# EasyEDA Pro project PRO_project.eprj, schematic Schematic1 (continued)
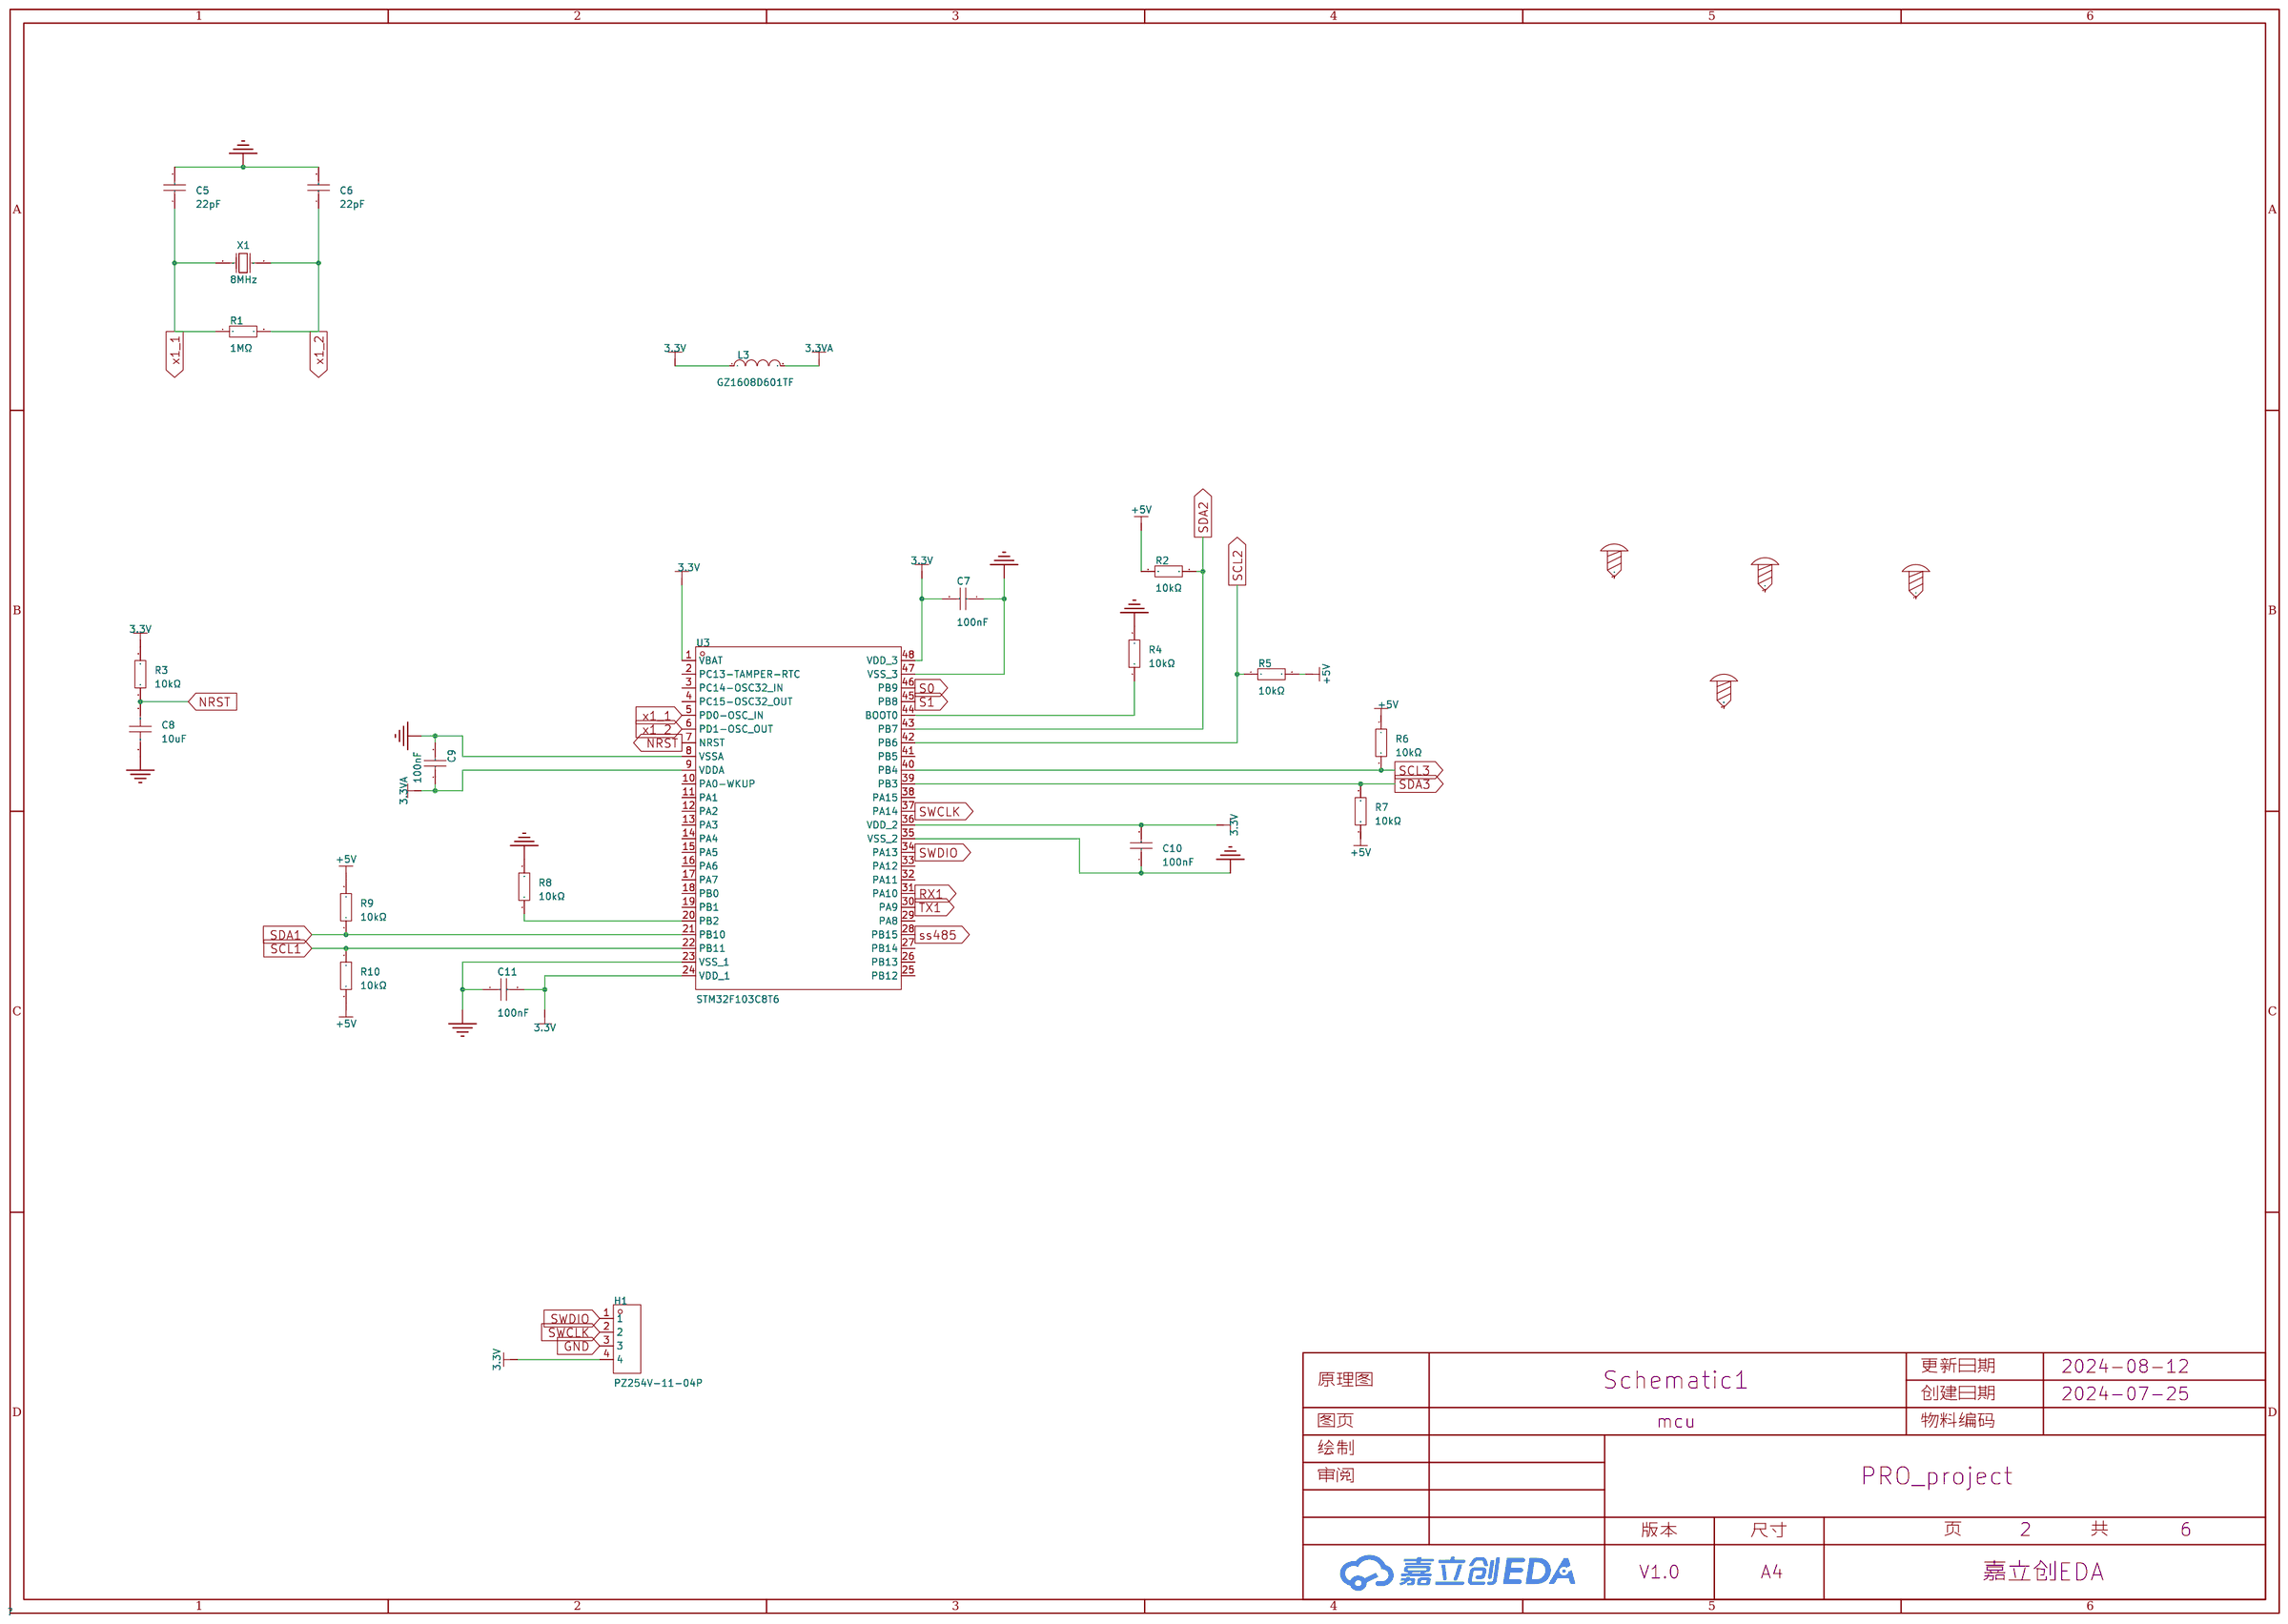
[diagram p0: mcu]
## Parts (continued)
L3  GZ1608D601TF  [L0603]
R1  1MΩ  [R0603]
R2  10kΩ  [R0603]
R3  10kΩ  [R0402]
R4  10kΩ  [R0402]
R5  10kΩ  [R0603]
R6  10kΩ  [R0603]
R7  10kΩ  [R0603]
R8  10kΩ  [R0402]
R9  10kΩ  [R0603]
R10  10kΩ  [R0603]
SCREW1  -  [M3螺丝]
SCREW2  -  [M3螺丝]
SCREW3  -  [M3螺丝]
SCREW4  -  [M3螺丝]
U3  STM32F103C8T6  [LQFP-48_L7.0-W7.0-P0.50-LS9.0-BL]
X1  8MHz  [HC-49US_L11.5-W4.5-P4.88]
sheet power
C1  680uF  [CAP-TH_BD12.5-P5.00-D0.6-FD]
C2  220uF  [CAP-TH_BD6.3-P2.50-D1.0-FD]
C3  220uF  [CAP-TH_BD6.3-P2.50-D1.0-FD]
C4  100nF  [C0402]
CN1  WJ2EDGV-5.08-2P  [CONN-TH_WJ2EDGV-5.08-2P]
D1  US1M  [SMA_L4.4-W2.8-LS5.4-RD]
D2  SMBJ26CA  [SMB_L4.4-W3.6-LS5.3-BI]
D3  SS54  [SMA_L4.3-W2.6-LS5.0-FD]
L1  100uH  [IND-SMD_L7.3-W7.3-1]
L2  33uH  [IND-SMD_L3.5-W3.0]
U1  LM2596S-5.0  [TO-263-5_L10.2-W8.9-P1.70-BR]
U2  AMS1117-3.3  [SOT-223-3_L6.5-W3.4-P2.30-LS7.0-BR]
sheet rs485
C54  4.7uF  [C0603]
C55  10uF  [C0603]
CN14  WJ2EDGV-5.08-2P  [CONN-TH_WJ2EDGV-5.08-2P]
D4  P6SMB6.8CA/TR13  [SMB_L4.6-W3.6-LS5.3-BI]
R59  4.7kΩ  [R0603]
R60  120Ω  [R0603]
R61  4.7kΩ  [R0603]
R62  470Ω  [R0603]
R63  470Ω  [R0603]
R64  470Ω  [R0603]
R65  470Ω  [R0603]
R66  470Ω  [R0603]
R67  470Ω  [R0603]
U34  SP485EEN-L/TR  [SOIC-8_L5.0-W4.0-P1.27-LS6.0-BL]
U35  PC817C-S  [SOP-4_L6.5-W4.6-P2.54-LS10.3-TL]
U36  -  [iCash-B0505-Right]
U37  PC817C-S  [SOP-4_L6.5-W4.6-P2.54-LS10.3-TL]
U38  PC817C-S  [SOP-4_L6.5-W4.6-P2.54-LS10.3-TL]

## Library data of the parts
C12-C15 C24-C27 C36-C39 = 0603B331K500NT: 容值:330pF;精度:±10%;额定电压:50V;材质(温度系数):X7R;; LCSC Part Name: 330pF ±10% 50V; Supplier Part: C1612; Manufacturer: FH(风华); Supplier Footprint: 0603; JLCPCB Part Class: Extended Part; Datasheet: https://atta.szlcsc.com/upload/public/pdf/source/20200305/C486355_26A10D38EF8C2A5C37091D0039909270.pdf; Supplier: LCSC; Tolerance: ±10%; Voltage Rated: 50V; Temperature Coefficient: X7R
C8 C16-C19 C28-C31 C40-C43 C55 = CL10A106KP8NNNC: 容值:10uF;精度:±10%;额定电压:10V;材质(温度系数):X5R;; LCSC Part Name: 10uF ±10% 10V; Supplier Part: C19702; Manufacturer: SAMSUNG(三星); Supplier Footprint: 0603; JLCPCB Part Class: Basic Part; Datasheet: https://atta.szlcsc.com/upload/public/pdf/source/20160218/1457707763339.pdf; Supplier: LCSC; Tolerance: ±10%; Voltage Rated: 10V; Temperature Coefficient: X5R
C20-C23 C32-C35 C44-C47 C54 = CL10A475KO8NNNC: 容值:4.7uF;精度:±10%;额定电压:16V;材质(温度系数):X5R;; LCSC Part Name: 4.7uF ±10% 16V; Supplier Part: C19666; Manufacturer: SAMSUNG(三星); Supplier Footprint: 0603; JLCPCB Part Class: Basic Part; Datasheet: https://atta.szlcsc.com/upload/public/pdf/source/20160218/1457707763339.pdf; Supplier: LCSC; Tolerance: ±10%; Voltage Rated: 16V; Temperature Coefficient: X5R
CN1-CN14 = WJ2EDGV-5.08-2P: 连接器类型:板端/插座-开口;结构:1x2P;间距:5.08mm;颜色:绿色;安装方式:直针;排数:1;每排PIN数:2;; LCSC Part Name: 5.08mm 1x2P 排数:1 每排P数:2; Supplier Part: C8461; Manufacturer: KANGNEX(康奈克斯电气); Supplier Footprint: 插件,P=5.08mm; JLCPCB Part Class: Extended Part; Datasheet: https://atta.szlcsc.com/upload/public/pdf/source/20191225/C8461_177EB00EC60F9C1AD12B590D31C8666C.pdf; Supplier: LCSC; Connector Type: 板端/插座-开口; Structure: 1x2P; Pitch: 5.08mm; Color: 绿色; Mounting Style: 直针; Number of Pins: 2P; Number of Rows: 1; Number of PINs Per Row: 2
R11-R18 R27-R34 R43-R50 = 1206W4F8202T5E: 电阻类型:厚膜电阻;阻值:82kΩ;精度:±1%;功率:250mW;最大工作电压:200V;温度系数:±100ppm/℃;; LCSC Part Name: 82kΩ ±1% 250mW 厚膜电阻; Supplier Part: C17979; Manufacturer: UNI-ROYAL(厚声); Supplier Footprint: 1206; JLCPCB Part Class: Extended Part; Datasheet: https://atta.szlcsc.com/upload/public/pdf/source/20200306/C422600_1E6D84923E4A46A82E41ADD87F860B5C.pdf; Supplier: LCSC; Type: 厚膜电阻; Tolerance: ±1%; Power(Watts): 250mW; Overload Voltage (Max): 200V; Temperature Coefficient: ±100ppm/℃; Operating Temperature Range: -55℃~+155℃
R19-R26 R35-R42 R51-R58 = FRC1206F3241TS: 电阻类型:厚膜电阻;阻值:3.24kΩ;精度:±1%;功率:250mW;最大工作电压:200V;温度系数:±100ppm/℃;; LCSC Part Name: 3.24kΩ ±1% 250mW 厚膜电阻; Supplier Part: C5153989; Manufacturer: FOJAN(富捷); Supplier Footprint: 1206; JLCPCB Part Class: Extended Part; Datasheet: https://atta.szlcsc.com/upload/public/pdf/source/20211221/925EC7D7225764EE0046F22065062C87.pdf; Supplier: LCSC; Type: 厚膜电阻; Tolerance: ±1%; Power(Watts): 250mW; Overload Voltage (Max): 200V; Temperature Coefficient: ±100ppm/℃
U4-U7 U12-U15 U20-U23 = AMC1200BDWVR: 放大器数:单路;-3dB带宽:100kHz;输入偏置电流(Ib):-;输入失调电压(Vos):200uV;; Supplier Part: C79905; Manufacturer: TI(德州仪器); Supplier Footprint: SOIC-8-300mil; JLCPCB Part Class: Extended Part; Datasheet: https://www.ti.com/cn/lit/gpn/amc1200; Supplier: LCSC; Number of Channels: 单路; Bandwidth (-3dB): 100kHz; Input Offset Voltage (Vos): 200uV; Operating Temperature: -40℃~+105℃
U8-U11 U16-U19 U24-U27 U36 = iCash-B0505封装
C4 C7 C9-C11 C48-C53 = CL05B104KO5NNNC: 容值:100nF;精度:±10%;额定电压:16V;材质(温度系数):X7R;; LCSC Part Name: 100nF ±10% 16V; Supplier Part: C1525; Manufacturer: SAMSUNG(三星); Supplier Footprint: 0402; JLCPCB Part Class: Basic Part; Datasheet: https://atta.szlcsc.com/upload/public/pdf/source/20160218/1457707763339.pdf; Supplier: LCSC; Tolerance: ±10%; Voltage Rated: 16V; Temperature Coefficient: X7R
U28 U30 U32 = 74HC4052D,653: 开关电路:单刀四掷(SP4T);通道数:2;导通电阻(Ron@VCC):150Ω;; LCSC Part Name: 双4通道模拟复用器 解复用器; Supplier Part: C11350; Manufacturer: Nexperia(安世); Supplier Footprint: SOIC-16; JLCPCB Part Class: Extended Part; Datasheet: https://atta.szlcsc.com/upload/public/pdf/source/20130225/1457706594415.pdf; Supplier: LCSC; Switch Circuit: 单刀四掷(SP4T); Number of Channels: 2; Supply Voltage: 2V~10V; Turn-on time: 58ns; On-State Resistance (Max): 150Ω; Turn-off time: 48ns
U29 U31 U33 = ADS1110A0IDBVR: 接口:I2C;电源电压:2.7V~5.5V;采样率:240Hz;分辨率:16位;; Supplier Part: C16598; Manufacturer: TI(德州仪器); Supplier Footprint: SOT-23-6; JLCPCB Part Class: Extended Part; Datasheet: http://www.ti.com/cn/lit/gpn/ads1110; Supplier: LCSC; Interface: I2C; differential input: 是; number of channels: 1; Supply Voltage: 2.7V~5.5V; sampling frequency: 240Hz; resolution: 16位; Operating Temperature: -40℃~+125℃
C5 C6 = 0402CG220J500NT: 容值:22pF;精度:±5%;额定电压:50V;材质(温度系数):C0G;; LCSC Part Name: 22pF ±5% 50V; Supplier Part: C1555; Manufacturer: FH(风华); Supplier Footprint: 0402; JLCPCB Part Class: Basic Part; Datasheet: https://atta.szlcsc.com/upload/public/pdf/source/20200305/C486355_26A10D38EF8C2A5C37091D0039909270.pdf; Supplier: LCSC; Tolerance: ±5%; Voltage Rated: 50V; Temperature Coefficient: C0G
H1 = PZ254V-11-04P: 插针结构:1x4P;间距:2.54mm;行距:-;圆针/方针:方针;安装类型:直插;排数:单排;总PIN位数:4P;额定电流:3A;额定电压:250V;配合针长度:6mm;塑高:2.5mm;端接针长度:3mm;触头材质:-;工作温度范围:-40℃~+105℃;颜色:黑色;; LCSC Part Name: 间距:2.54mm 1x4P 直插 方针; Supplier Part: C2691448; Manufacturer: XFCN(兴飞); Supplier Footprint: 插件,P=2.54mm; JLCPCB Part Class: Extended Part; Datasheet: https://atta.szlcsc.com/upload/public/pdf/source/20200309/C492403_F9F19131791D08044AD4F84F8E751A34.pdf; Supplier: LCSC; Pin Structure: 1x4P; Pitch: 2.54mm; Circluar Pins/Square Pins: 方针; Mounting Type: 直插; Number of Rows: 单排; Number of Pins: 4P; Current Rating (Max): 3A; Voltage Rating (Max): 250V; Length of Mating Pin: 6mm; Insulation Height: 2.5mm; Length of End Connection Pin: 3mm; Operating Temperature Range: -40℃~+105℃; Color: 黑色
L3 = GZ1608D601TF: 标称阻抗@测试频率:600Ω@100MHz;误差:±25%;直流电阻(RDC):450mΩ;; LCSC Part Name: 单路 0603磁珠 阻抗600Ω@100MHz; Supplier Part: C1002; Manufacturer: Sunlord(顺络); Supplier Footprint: 0603; JLCPCB Part Class: Basic Part; Datasheet: https://atta.szlcsc.com/upload/public/pdf/source/20231030/9B6A3E87682CEC1FF6638DFAA81D73FA.pdf; Supplier: LCSC; Impedance @ Frequency: 600Ω@100MHz; Tolerance: ±25%; DC Resistance: 450mΩ; Current Rating: 200mA; Circuits: 1
R1 = 0603WAF1004T5E: 电阻类型:厚膜电阻;阻值:1MΩ;精度:±1%;功率:100mW;最大工作电压:75V;温度系数:±100ppm/℃;; LCSC Part Name: 1MΩ ±1% 100mW 厚膜电阻; Supplier Part: C22935; Manufacturer: UNI-ROYAL(厚声); Supplier Footprint: 0603; JLCPCB Part Class: Basic Part; Datasheet: https://atta.szlcsc.com/upload/public/pdf/source/20200306/C422600_1E6D84923E4A46A82E41ADD87F860B5C.pdf; Supplier: LCSC; Type: 厚膜电阻; Tolerance: ±1%; Power(Watts): 100mW; Overload Voltage (Max): 75V; Temperature Coefficient: ±100ppm/℃; Operating Temperature Range: -55℃~+155℃
R2 R5-R7 R9 R10 = 0603WAF3241T5E: 电阻类型:厚膜电阻;阻值:3.24kΩ;精度:±1%;功率:100mW;最大工作电压:75V;温度系数:±100ppm/℃;; LCSC Part Name: 3.24kΩ ±1% 100mW 厚膜电阻; Supplier Part: C22994; Manufacturer: UNI-ROYAL(厚声); Supplier Footprint: 0603; JLCPCB Part Class: Extended Part; Datasheet: https://atta.szlcsc.com/upload/public/pdf/source/20200306/C422600_1E6D84923E4A46A82E41ADD87F860B5C.pdf; Supplier: LCSC; Type: 厚膜电阻; Tolerance: ±1%; Power(Watts): 100mW; Overload Voltage (Max): 75V; Temperature Coefficient: ±100ppm/℃; Operating Temperature Range: -55℃~+155℃
R3 R4 R8 = 0402WGF1002TCE: 电阻类型:厚膜电阻;阻值:10kΩ;精度:±1%;功率:62.5mW;最大工作电压:50V;温度系数:±100ppm/℃;; LCSC Part Name: 10kΩ ±1% 62.5mW 厚膜电阻; Supplier Part: C25744; Manufacturer: UNI-ROYAL(厚声); Supplier Footprint: 0402; JLCPCB Part Class: Basic Part; Datasheet: https://atta.szlcsc.com/upload/public/pdf/source/20200306/C422600_1E6D84923E4A46A82E41ADD87F860B5C.pdf; Supplier: LCSC; Type: 厚膜电阻; Tolerance: ±1%; Power(Watts): 62.5mW; Overload Voltage (Max): 50V; Temperature Coefficient: ±100ppm/℃; Operating Temperature Range: -55℃~+155℃
SCREW1-SCREW4 = M3螺丝: Supplier Footprint: 插件
U3 = STM32F103C8T6: CPU内核:ARM-M3;程序存储容量:64KB;RAM总容量:20KB;GPIO端口数量:37;工作电压范围:2V~3.6V;CPU最大主频:72MHz;程序存储器类型:FLASH;; Supplier Part: C8734; Manufacturer: ST(意法半导体); Supplier Footprint: LQFP-48(7x7); JLCPCB Part Class: Extended Part; Datasheet: https://atta.szlcsc.com/upload/public/pdf/source/20220812/8363ACEC51AD55ECEB84799464F7CB85.pdf; Supplier: LCSC; CPU Core: ARM-M3; Program Storage Size: 64KB; RAM Size: 20KB; GPIO Ports Number: 37; Operating Voltage Range: 2V~3.6V; CPU Maximum Speed: 72MHz; Program Memory Type: FLASH; Operating Temperature Range: -40℃~+85℃; ADC (Bit): 12bit; Universal Serial Bus: 有; Peripheral/Function: 看门狗；DMA；看门狗；温度传感器; Watchdog: 有; Infrared Data Association: 有; Low-Voltage Detect: 有; Direct Memory Access: 有; Internal Oscillator: 有
X1 = TAXD8M2GLFBET2T: 晶振类型:直插晶振;频率:8MHz;常温频差:±30ppm;外接负载电容:20pF;频率稳定度(全温):±30ppm;; LCSC Part Name: 8MHz ±30ppm 20pF; Supplier Part: C107425; Manufacturer: YJX(雅晶鑫); Supplier Footprint: HC-49S; JLCPCB Part Class: Extended Part; Datasheet: https://atta.szlcsc.com/upload/public/pdf/source/20170914/C127676_1505359415156967690.pdf; Supplier: LCSC; Crystal Type: 直插晶振; Normal temperature Frequency Tolerance: ±30ppm; External load capacitor: 20pF; Frequency Stability(Full temperature range): ±30ppm; Equivalent Series Resistance (ESR): 80Ω; Operating Temperature: -20℃~+70℃
C1 = ERS1HM681W20OT: 容值:680uF;精度:±20%;额定电压:50V;; LCSC Part Name: 680uF ±20% 50V; Supplier Part: C106668; Manufacturer: AISHI(艾华集团); Supplier Footprint: 插件,D12.5xL20mm; JLCPCB Part Class: Extended Part; Datasheet: https://atta.szlcsc.com/upload/public/pdf/source/20191015/C438940_4B8E60A742BB0AE40DDEF87A5C89089D.pdf; Supplier: LCSC; Tolerance: ±20%; Rated Voltage: 50V; Lead Spacing: 5mm; φD: 12.5mm; L: 20mm; Lifetime @ Temp: 10000hrs@105℃
C2 C3 = GR227M025E12RR0VH4FP0: 容值:220uF;精度:±20%;额定电压:25V;纹波电流:-;等效串联电阻:-;; LCSC Part Name: 220uF ±20% 25V 黑; Supplier Part: C43838; Manufacturer: CX(承兴); Supplier Footprint: 插件,D6.3xL12mm; JLCPCB Part Class: Extended Part; Datasheet: https://atta.szlcsc.com/upload/public/pdf/source/20211027/ED0DA65C69F42D9BDEC91091BA4C03CD.pdf; Supplier: LCSC; Tolerance: ±20%; Rated Voltage: 25V; Lead Spacing: 2.5mm; φD: 6.3mm; L: 12mm; Lifetime @ Temp: 2000hrs@105℃; Operating Temperature: -40℃~+105℃
D1 = US1M_C412437: 二极管配置:独立式;正向压降(Vf):1.65V@1A;直流反向耐压(Vr):1kV;整流电流:1A;反向恢复时间(trr):75ns;; LCSC Part Name: 电压:1kV 电流:1A; Supplier Part: C412437; Manufacturer: MDD(辰达半导体); Supplier Footprint: SMA; JLCPCB Part Class: Basic Part; Datasheet: https://atta.szlcsc.com/upload/public/pdf/source/20230314/F0756B025DF5B8F55B4CA0C779F501E8.pdf; Supplier: LCSC; Diode Configuration: 独立式; Forward Voltage (Vf@If): 1.65V@1A; Reverse Voltage (Vr): 1kV; Rectified Current: 1A; Reverse Leakage Current: 5uA@1kV; Reverse Recovery Time (trr): 75ns; Operating Temperature: -55℃~+150℃@(Tj)
D2 = SMBJ26CA_C908854: 反向截止电压(Vrwm):26V;最大钳位电压:42.1V;峰值脉冲电流(Ipp)@10/1000us:14.2A;击穿电压:28.9V;; Supplier Part: C908854; Manufacturer: GOODWORK(固得沃克); Supplier Footprint: SMB(DO-214AA); JLCPCB Part Class: Extended Part; Datasheet: https://atta.szlcsc.com/upload/public/pdf/source/20201231/C908783_5F0AE07776753216FC0A4122EEBBB8E2.pdf; Supplier: LCSC; Reverse Stand-Off Voltage (Vrwm): 26V; Maximum Clamping Voltage: 42.1V; Peak Pulse Current (Ipp)@10/1000us: 14.2A; Breakdown Voltage: 28.9V; Reverse Leakage Current (Ir): 5uA; Type: TVS
D3 = SS54_C7420369: 二极管配置:独立式;正向压降(Vf):550mV@5.0A;直流反向耐压(Vr):40V;平均整流电流(Io):5A;; LCSC Part Name: 电压:40V 电流:5A; Supplier Part: C7420369; Manufacturer: 宏迦橙; Supplier Footprint: SMA(DO-214AC); JLCPCB Part Class: Extended Part; Datasheet: https://atta.szlcsc.com/upload/public/pdf/source/20230828/254C3882F8647358AD9F60DD73611B5E.pdf; Supplier: LCSC; Diode Configuration: 独立式; Forward Voltage (Vf@If): 550mV@5.0A; Reverse Voltage (Vr): 40V; Average Rectified Current (Io): 5A; Reverse Leakage Current (Ir): 50uA@40V; Peak forward surge current: 120A
L1 = YPRH0704-101M: 电感值:100uH;精度:±20%;额定电流:600mA;; LCSC Part Name: 100uH ±20%; Supplier Part: C514812; Manufacturer: YJYCOIN(益嘉源); Supplier Footprint: SMD,7.3x7.3mm; JLCPCB Part Class: Extended Part; Datasheet: https://atta.szlcsc.com/upload/public/pdf/source/20200415/C514805_A0DEE7A5C2CBBD84C043B11E55CA01C7.pdf; Supplier: LCSC; Tolerance: ±20%; Rated Current: 600mA; DC Resistance (DCR): 610mΩ
L2 = CD32YP0302-330M: 电感值:33uH;精度:±20%;额定电流:600mA;; LCSC Part Name: 33uH ±20%; Supplier Part: C492262; Manufacturer: YJYCOIN(益嘉源); Supplier Footprint: SMD,3.5x3x2.1mm; JLCPCB Part Class: Extended Part; Datasheet: https://atta.szlcsc.com/upload/public/pdf/source/20200311/C492266_3C4DCA97B8B94D4CA8DBD234C7C1D8A4.pdf; Supplier: LCSC; Tolerance: ±20%; Rated Current: 600mA; DC Resistance (DCR): 951mΩ
U1 = LM2596S-5.0_C347421: 功能类型:降压型;输出类型:固定;输入电压:40V;输出电压:5V;输出电流(最大值):3A;; Supplier Part: C347421; Manufacturer: UMW(友台半导体); Supplier Footprint: TO-263-5; JLCPCB Part Class: Extended Part; Datasheet: https://atta.szlcsc.com/upload/public/pdf/source/20230506/0930E65C3A8B7B120C8A4D8E5A8AC327.pdf; Supplier: LCSC; Function: 降压型; Output Type: 固定; Input Voltage: 40V; Output Voltage: 5V; Output Current (Max): 3A; Switching Frequency: 150kHz; Operating Temperature: -40℃~+125℃@(TA); Synchronous Rectification: 否; Number of Outputs: 1; Topology: 降压式; Switch tube (built-in/external): 内置
U2 = AMS1117-3.3_C6186: 输出类型:固定;最大输入电压:-;输出电压:3.3V;最大输出电流:1A;电源纹波抑制比(PSRR):72dB@(120Hz);输出极性:正极;; LCSC Part Name: 输出3.3V 1A; Supplier Part: C6186; Manufacturer: AMS; Supplier Footprint: SOT-223; JLCPCB Part Class: Basic Part; Datasheet: https://atta.szlcsc.com/upload/public/pdf/source/20180727/C6186_7A095716F0823C02F1997A905E26C086.pdf; Supplier: LCSC; Output Type: 固定; Output Voltage: 3.3V; MAX Output Current: 1A; Power Supply Rejection Ratio (PSRR): 72dB@(120Hz); Dropout Voltage: 1.3V@(800mA); Output Polarity: 正极; Number of Outputs: 1
D4 = P6SMB6.8CA/TR13: 反向截止电压(Vrwm):5.8V;最大钳位电压:10.5V;峰值脉冲电流(Ipp)@10/1000us:58.1A;峰值脉冲功率(Ppp)@10/1000us:600W;击穿电压:6.45V;; Supplier Part: C78395; Manufacturer: Brightking(君耀电子); Supplier Footprint: SMB(DO-214AA); JLCPCB Part Class: Basic Part; Datasheet: https://atta.szlcsc.com/upload/public/pdf/source/20160709/1468031879762.pdf; Supplier: LCSC; Reverse Stand-Off Voltage (Vrwm): 5.8V; Maximum Clamping Voltage: 10.5V; Peak Pulse Current (Ipp)@10/1000us: 58.1A; Peak Pulse Power Dissipation (Ppp)@10/1000us: 600W; Breakdown Voltage: 6.45V; Type: TVS
R59 R61 = 0603WAF4701T5E: 电阻类型:厚膜电阻;阻值:4.7kΩ;精度:±1%;功率:100mW;最大工作电压:75V;温度系数:±100ppm/℃;; LCSC Part Name: 4.7kΩ ±1% 100mW 厚膜电阻; Supplier Part: C23162; Manufacturer: UNI-ROYAL(厚声); Supplier Footprint: 0603; JLCPCB Part Class: Basic Part; Datasheet: https://atta.szlcsc.com/upload/public/pdf/source/20200306/C422600_1E6D84923E4A46A82E41ADD87F860B5C.pdf; Supplier: LCSC; Type: 厚膜电阻; Tolerance: ±1%; Power(Watts): 100mW; Overload Voltage (Max): 75V; Temperature Coefficient: ±100ppm/℃; Operating Temperature Range: -55℃~+155℃
R60 = 0603WAF1200T5E: 电阻类型:厚膜电阻;阻值:120Ω;精度:±1%;功率:100mW;最大工作电压:75V;温度系数:±100ppm/℃;; LCSC Part Name: 120Ω ±1% 100mW 厚膜电阻; Supplier Part: C22787; Manufacturer: UNI-ROYAL(厚声); Supplier Footprint: 0603; JLCPCB Part Class: Basic Part; Datasheet: https://atta.szlcsc.com/upload/public/pdf/source/20200306/C422600_1E6D84923E4A46A82E41ADD87F860B5C.pdf; Supplier: LCSC; Type: 厚膜电阻; Tolerance: ±1%; Power(Watts): 100mW; Overload Voltage (Max): 75V; Temperature Coefficient: ±100ppm/℃; Operating Temperature Range: -55℃~+155℃
R62-R67 = 0603WAF4700T5E: 电阻类型:厚膜电阻;阻值:470Ω;精度:±1%;功率:100mW;最大工作电压:75V;温度系数:±100ppm/℃;; LCSC Part Name: 470Ω ±1% 100mW 厚膜电阻; Supplier Part: C23179; Manufacturer: UNI-ROYAL(厚声); Supplier Footprint: 0603; JLCPCB Part Class: Basic Part; Datasheet: https://atta.szlcsc.com/upload/public/pdf/source/20200306/C422600_1E6D84923E4A46A82E41ADD87F860B5C.pdf; Supplier: LCSC; Type: 厚膜电阻; Tolerance: ±1%; Power(Watts): 100mW; Overload Voltage (Max): 75V; Temperature Coefficient: ±100ppm/℃; Operating Temperature Range: -55℃~+155℃
U34 = SP485EEN-L/TR: 类型:收发器;数据速率:10Mbps;驱动器/接收器:1/1;; LCSC Part Name: 增强型低功耗半双工RS-485收发器; Supplier Part: C6855; Manufacturer: MaxLinear(迈凌); Supplier Footprint: SOIC-8; JLCPCB Part Class: Basic Part; Datasheet: https://atta.szlcsc.com/upload/public/pdf/source/20210125/C916163_66C97B5ACCC910994E8B10780F9BD300.pdf; Supplier: LCSC; Types: 收发器; Supply Voltage: 4.75V~5.25V; Data Rate: 10Mbps; Driver/receiver: 1/1; Operating Temperature: -40℃~+85℃
U35 U37 U38 = PC817C-S: LCSC Part Name: 光耦; Supplier Part: C3008369; Manufacturer: UMW(友台半导体); Supplier Footprint: SOP-4-2.54mm; JLCPCB Part Class: Extended Part; Datasheet: https://atta.szlcsc.com/upload/public/pdf/source/20231109/4644CC05A9D09AF3A1056B42E9A17852.pdf; Supplier: LCSC

## Nets
3.3V: C4.1 C7.2 C10.2 C11.2 H1.4 L3.1 R3.2 R62.1 R64.1 R66.1 U2.2(VOUT) U2.4(VOUT) U3.1(VBAT) U3.24(VDD_1) U3.36(VDD_2) U3.48(VDD_3)
3.3VA: C9.1 L3.2 U3.9(VDDA)
+5V: C3.1 C20.2 C21.2 C22.2 C23.2 C32.2 C33.2 C34.2 C35.2 C44.2 C45.2 C46.2 C47.2 C48.1 C49.1 C50.1 C51.1 C52.1 C53.1 C54.1 L2.2 R2.1 R5.2 R6.1 R7.1 R9.2 R10.2 U1.4(FB) U2.3(VIN) U4.8(VDD2) U5.8(VDD2) U6.8(VDD2) U7.8(VDD2) U8.2(Vin+) U9.2(Vin+) U10.2(Vin+) U11.2(Vin+) U12.8(VDD2) U13.8(VDD2) U14.8(VDD2) U15.8(VDD2) U16.2(Vin+) U17.2(Vin+) U18.2(Vin+) U19.2(Vin+) U20.8(VDD2) U21.8(VDD2) U22.8(VDD2) U23.8(VDD2) U24.2(Vin+) U25.2(Vin+) U26.2(Vin+) U27.2(Vin+) U28.16(VCC) U29.5(VDD) U30.16(VCC) U31.5(VDD) U32.16(VCC) U33.5(VDD) U36.2(Vin+)
GND: C1.2 C2.2 C3.2 C4.2 C5.2 C6.2 C7.1 C8.1 C9.2 C10.1 C11.1 C20.1 C21.1 C22.1 C23.1 C32.1 C33.1 C34.1 C35.1 C44.1 C45.1 C46.1 C47.1 C48.2 C49.2 C50.2 C51.2 C52.2 C53.2 C54.2 CN1.2 D2.1 D3.1(A) H1.3 R4.2 R8.1 U1.3(GND) U1.5(ON#/OFF) U1.6(EP) U2.1(GND) U3.8(VSSA) U3.23(VSS_1) U3.35(VSS_2) U3.47(VSS_3) U4.5(GND2) U5.5(GND2) U6.5(GND2) U7.5(GND2) U8.1(Vin-) U9.1(Vin-) U10.1(Vin-) U11.1(Vin-) U12.5(GND2) U13.5(GND2) U14.5(GND2) U15.5(GND2) U16.1(Vin-) U17.1(Vin-) U18.1(Vin-) U19.1(Vin-) U20.5(GND2) U21.5(GND2) U22.5(GND2) U23.5(GND2) U24.1(Vin-) U25.1(Vin-) U26.1(Vin-) U27.1(Vin-) U28.6(E#) U28.7(VEE) U28.8(GND) U29.2(GND) U30.6(E#) U30.7(VEE) U30.8(GND) U31.2(GND) U32.6(E#) U32.7(VEE) U32.8(GND) U33.2(GND) U36.1(Vin-) U38.3(EM)
1N0: U5.6(VOUTN) U28.1(2Y0)
1N1: U6.6(VOUTN) U28.5(2Y1)
1N2: U4.6(VOUTN) U28.2(2Y2)
1N3: U7.6(VOUTN) U28.4(2Y3)
1P0: U5.7(VOUTP) U28.12(1Y0)
1P1: U6.7(VOUTP) U28.14(1Y1)
1P2: U4.7(VOUTP) U28.15(1Y2)
1P3: U7.7(VOUTP) U28.11(1Y3)
1ZN: U28.3(2Z) U29.1(VIN+)
1ZP: U28.13(1Z) U29.6(VIN-)
2N0: U14.6(VOUTN) U30.1(2Y0)
2N1: U12.6(VOUTN) U30.5(2Y1)
2N2: U13.6(VOUTN) U30.2(2Y2)
2N3: U15.6(VOUTN) U30.4(2Y3)
2P0: U14.7(VOUTP) U30.12(1Y0)
2P1: U12.7(VOUTP) U30.14(1Y1)
2P2: U13.7(VOUTP) U30.15(1Y2)
2P3: U15.7(VOUTP) U30.11(1Y3)
2ZN: U30.3(2Z) U31.1(VIN+)
2ZP: U30.13(1Z) U31.6(VIN-)
3N0: U21.6(VOUTN) U32.1(2Y0)
3N1: U20.6(VOUTN) U32.5(2Y1)
3N2: U23.6(VOUTN) U32.2(2Y2)
3N3: U22.6(VOUTN) U32.4(2Y3)
3P0: U21.7(VOUTP) U32.12(1Y0)
3P1: U20.7(VOUTP) U32.14(1Y1)
3P2: U23.7(VOUTP) U32.15(1Y2)
3P3: U22.7(VOUTP) U32.11(1Y3)
3ZN: U32.3(2Z) U33.1(VIN+)
3ZP: U32.13(1Z) U33.6(VIN-)
485+: C55.2 R61.1 R63.2 R67.2 U34.8(VCC) U36.4(Vout+) U37.4(COL)
485-: C55.1 R59.2 R65.1 U34.5(GND) U35.3(EM) U36.3(Vout-)
DI: R63.1 U34.4(DI) U35.4(COL)
NRST: C8.2 R3.1 U3.7(NRST)
RO: U34.1(RO) U38.2(CAT)
RX1: R66.2 U3.31(PA10) U38.4(COL)
S0: U3.46(PB9) U28.10(S0) U30.10(S0) U32.10(S0)
S1: U3.45(PB8) U28.9(S1) U30.9(S1) U32.9(S1)
SCL1: R10.1 U3.22(PB11) U29.3(SCL)
SCL2: R5.1 U3.42(PB6) U31.3(SCL)
SCL3: R6.2 U3.40(PB4) U33.3(SCL)
SDA1: R9.1 U3.21(PB10) U29.4(SDA)
SDA2: R2.2 U3.43(PB7) U31.4(SDA)
SDA3: R7.2 U3.39(PB3) U33.4(SDA)
SS: R65.2 U34.2(RE#) U34.3(DE) U37.3(EM)
ss485: U3.28(PB15) U37.2(CAT)
SWCLK: H1.2 U3.37(PA14)
SWDIO: H1.1 U3.34(PA13)
TX1: U3.30(PA9) U35.2(CAT)
x1_1: C5.1 R1.1 U3.5(PD0-OSC_IN) X1.2(OSC2)
x1_2: C6.1 R1.2 U3.6(PD1-OSC_OUT) X1.1(OSC1)
$1N1353: R4.1 U3.44(BOOT0)
$1N9152: R8.2 U3.20(PB2)
$2N657: D3.2(K) L1.2 U1.2(OUT)
$2N1653: C2.1 L1.1 L2.1
$2N2288: CN1.1 D1.2(A) D2.2
$2N2289: C1.1 D1.1(C) U1.1(VIN)
$3N444: R21.1 R22.1
$3N877: C17.1 U5.4(GND1) U9.3(Vout-)
$3N883: C17.2 U5.1(VDD1) U9.4(Vout+)
$3N1473: CN4.1 R15.2
$3N1476: CN4.2 R16.2
$3N1479: R23.1 R24.1
$3N1489: C14.1 R15.1 R23.2 U6.3(VINN)
$3N1497: C14.2 R16.1 R24.2 U6.2(VINP)
$3N1505: C18.1 U6.4(GND1) U10.3(Vout-)
$3N1512: C18.2 U6.1(VDD1) U10.4(Vout+)
$3N1940: CN2.1 R11.2
$3N1943: CN2.2 R12.2
$3N1946: R19.1 R20.1
$3N1956: C12.1 R11.1 R19.2 U4.3(VINN)
$3N1964: C12.2 R12.1 R20.2 U4.2(VINP)
$3N1972: C16.1 U4.4(GND1) U8.3(Vout-)
$3N1979: C16.2 U4.1(VDD1) U8.4(Vout+)
$3N2407: CN5.1 R17.2
$3N2410: CN5.2 R18.2
$3N2413: R25.1 R26.1
$3N2423: C15.1 R17.1 R25.2 U7.3(VINN)
$3N2431: C15.2 R18.1 R26.2 U7.2(VINP)
$3N11930: CN6.1 R33.2
$3N11931: R39.1 R40.1
$3N11934: C26.1 R31.1 R39.2 U14.3(VINN)
$3N11935: C26.2 R32.1 R40.2 U14.2(VINP)
$3N11945: CN9.1 R29.2
$3N11946: R35.1 R36.1
$3N11949: C24.1 R27.1 R35.2 U12.3(VINN)
$3N11950: C24.2 R28.1 R36.2 U12.2(VINP)
$3N11960: CN7.1 R27.2
$3N11961: R37.1 R38.1
$3N11964: C25.1 R29.1 R37.2 U13.3(VINN)
$3N11965: C25.2 R30.1 R38.2 U13.2(VINP)
$3N11974: R41.1 R42.1
$3N11977: C27.1 R33.1 R41.2 U15.3(VINN)
$3N11978: C27.2 R34.1 R42.2 U15.2(VINP)
$3N13638: CN12.1 R45.2
$3N13639: R53.1 R54.1
$3N13642: C37.1 R45.1 R53.2 U21.3(VINN)
$3N13643: C37.2 R46.1 R54.2 U21.2(VINP)
$3N13644: C41.1 U21.4(GND1) U25.3(Vout-)
$3N13645: C41.2 U21.1(VDD1) U25.4(Vout+)
$3N13653: CN10.1 R43.2
$3N13654: R51.1 R52.1
$3N13657: C36.1 R43.1 R51.2 U20.3(VINN)
$3N13658: C36.2 R44.1 R52.2 U20.2(VINP)
$3N13659: C40.1 U20.4(GND1) U24.3(Vout-)
$3N13660: C40.2 U20.1(VDD1) U24.4(Vout+)
$3N13668: CN11.1 R49.2
$3N13669: R57.1 R58.1
$3N13672: C39.1 R49.1 R57.2 U23.3(VINN)
$3N13673: C39.2 R50.1 R58.2 U23.2(VINP)
$3N13674: C43.1 U23.4(GND1) U27.3(Vout-)
$3N13675: C43.2 U23.1(VDD1) U27.4(Vout+)
$3N13681: CN13.1 R47.2
$3N13682: R55.1 R56.1
$3N13685: C38.1 R47.1 R55.2 U22.3(VINN)
$3N13686: C38.2 R48.1 R56.2 U22.2(VINP)
$3N13687: C42.1 U22.4(GND1) U26.3(Vout-)
$3N13688: C42.2 U22.1(VDD1) U26.4(Vout+)
$3N18144: C30.1 U14.4(GND1) U18.3(Vout-)
$3N18145: C30.2 U14.1(VDD1) U18.4(Vout+)
$3N18189: C28.1 U12.4(GND1) U17.3(Vout-)
$3N18190: C28.2 U12.1(VDD1) U17.4(Vout+)
$3N18234: C29.1 U13.4(GND1) U16.3(Vout-)
$3N18235: C29.2 U13.1(VDD1) U16.4(Vout+)
$3N18279: C31.1 U15.4(GND1) U19.3(Vout-)
$3N18280: C31.2 U15.1(VDD1) U19.4(Vout+)
$3N18687: C19.1 U7.4(GND1) U11.3(Vout-)
$3N18688: C19.2 U7.1(VDD1) U11.4(Vout+)
$3N20010: C13.2 R13.1 R21.2 U5.3(VINN)
$3N20027: C13.1 R14.1 R22.2 U5.2(VINP)
$3N20036: CN3.1 R13.2
$3N20045: CN3.2 R14.2
$3N20240: CN8.1 R31.2
$3N20244: CN8.2 R32.2
$3N20274: CN7.2 R28.2
$3N20282: CN9.2 R30.2
$3N20291: CN6.2 R34.2
$3N20301: CN13.2 R48.2
$3N20311: CN12.2 R46.2
$3N20318: CN10.2 R44.2
$3N20331: CN11.2 R50.2
$4N2340: R64.2 U37.1(AN)
$4N2422: R67.1 U38.1(AN)
$4N4574: CN14.2 D4.1 R60.1 R61.2 U34.6(A)
$4N4575: CN14.1 D4.2 R59.1 R60.2 U34.7(B)
$4N5104: R62.2 U35.1(AN)

Not connected (* = marked no-connect by the designer): SCREW1 1; SCREW2 1; SCREW3 1; SCREW4 1; U3 2(PC13-TAMPER-RTC) 3(PC14-OSC32_IN) 4(PC15-OSC32_OUT) 10(PA0-WKUP) 11(PA1) 12(PA2) 13(PA3) 14(PA4) 15(PA5) 16(PA6) 17(PA7) 18(PB0) 19(PB1) 25(PB12) 26(PB13) 27(PB14) 29(PA8) 32(PA11) 33(PA12) 38(PA15) 41(PB5)
